# EasyEDA Pro project cubicat_pcb.eprj, board PCB
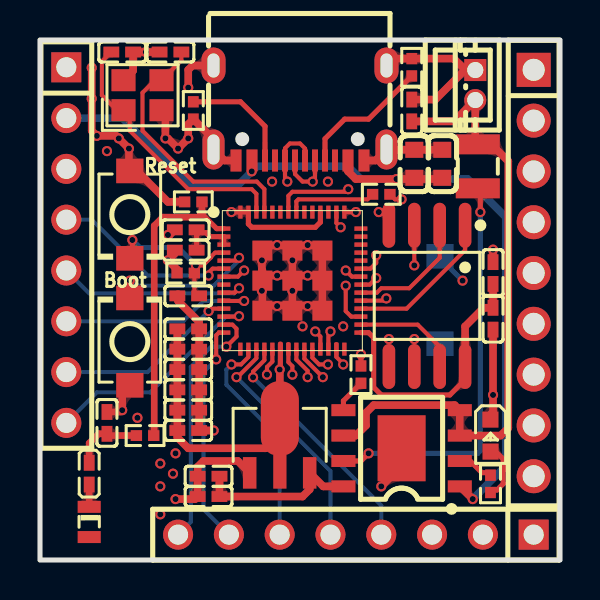
[diagram p7: board, top side]
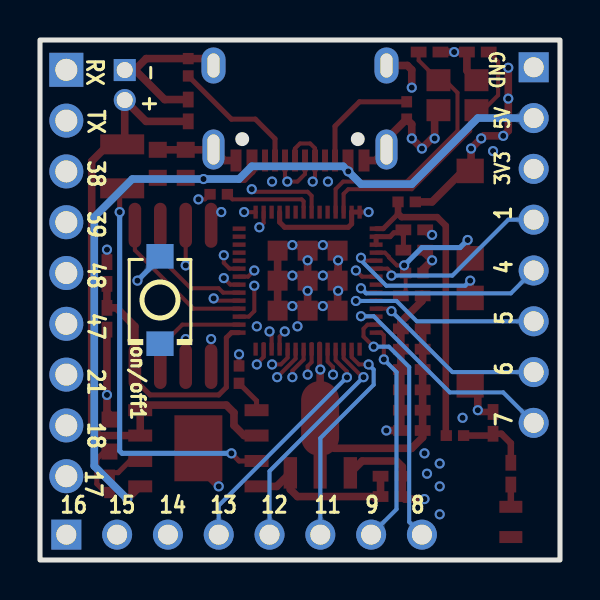
[diagram p8: board, bottom side, seen from below]

Outline 26 x 26 mm; copper layers: Top Layer, GND, PWR, Bottom Layer. Coordinates in mm from the lower left corner of the outline.
Outline path: rectangle 0,26 26,0
Stack: Top Layer 0.035mm 外层铜厚1oz / Dielectric1 0.2104mm 7628 RC49% 8.6mil / GND 0.0152mm 内层铜厚 / Dielectric2 1.065mm 1.1mm H/HOZ 含铜 / PWR 0.0152mm 内层铜厚 / Dielectric3 0.2104mm 7628 RC49% 8.6mil / Bottom Layer 0.035mm 外层铜厚1oz

## Design rules (mm)
net D-: USB-OTG
net D+: USB-OTG
template: 自定义配置
spacing copperThickness1oz (default): track to track 0.102, other pairs 0.152 to 0.3
spacing copperThickness2oz: track to track 0.203, other pairs 0.152 to 0.3
track width copperThickness1oz (default): min 0.127, default 0.254, max 2.54
track width copperThickness2oz: min 0.203, default 0.254, max 2.54
differential pair 90ohm (default): width min 0.203, default 0.203, max 0.229; gap min 0.152, default 0.203
via viaSize (default): diameter min 0.5, default 0.508, max 10; hole min 0.3, default 0.305, max 6.299

## Placement (name value [footprint] x y rotation side)
ANT1  KH-1608-H08  [ANT-SMD_L1.7-W0.9]  2.46 1.9 90 top
BAT1  A1501WV-2P  [CONN-TH_A1501WV-2P]  21.76 23.75 270 top
Boot  TS-1088-AR02016  [SW-SMD_L3.9-W3.0-P4.45]  4.49 10.92 90 top
C4  10uF  [C0402]  18.59 22.48 90 top
C6  10uF  [C0402]  8.43 3.17 180 top
C7  10uF  [C0603]  20.11 19.81 270 top
C8  10uF  [C0603]  18.72 19.81 270 top
C9  10uF  [C0402]  8.43 4.19 180 top
C13  10uF  [C0402]  7.41 7.49 180 top
C14  100nF  [C0402]  7.41 6.47 180 top
C15  1uF  [C0402]  7.41 13.21 0 top
C16  10uF  [C0402]  7.41 9.52 180 top
C17  1uF  [C0402]  7.41 11.56 180 top
C18  100nF  [C0402]  7.28 16.51 0 top
C20  15pF  [C0402]  4.11 25.4 0 top
C21  15pF  [C0402]  6.52 25.4 0 top
C22  1uF  [C0402]  7.41 8.51 180 top
C23  100nF  [C0402]  22.65 12.06 90 top
C24  1uF  [C0402]  22.65 14.35 270 top
C25  1.5pF  [C0402]  3.35 6.86 270 top
C30  10uF  [C0402]  7.41 10.54 180 top
ESP32S3R8  -  [esp32s3R8]  12.62 13.97 0 top
H1  PZ254V-11-09P  [HDR-TH_9P-P2.54-V-M]  24.68 14.35 270 top
L1  2.2uH  [IND-SMD_L2.5-W2.0_MHCHL2520]  21.89 19.68 90 top
L2  2nH  [L0402]  7.28 15.49 0 top
L3  5.6nH  [L0402]  2.46 4.32 90 top
LED1  19-213/Y2C-CQ2R2L/3T(CY)  [LED0603-RD-YELLOW]  22.53 6.22 270 top
on/off1  TS-1088-AR02016  [SW-SMD_L3.9-W3.0-P4.45]  20 13 270 bottom
Q1  AMS1117-3.3  [SOT-89_L4.5-W2.5-P1.50-LS4.2-BR]  11.98 5.71 270 top
R5  200Ω  [R0402]  22.53 3.81 90 top
R7  10kΩ  [R0402]  7.28 14.35 180 top
R9  5.1kΩ  [R0402]  7.67 22.48 90 top
R10  5.1kΩ  [R0402]  18.59 24.64 90 top
R11  10kΩ  [R0402]  16.05 9.27 90 top
R14  0Ω  [R0402]  5.25 6.22 0 top
R15  0Ω  [R0402]  7.67 17.91 0 top
R22  470Ω  [R0402]  17.06 18.29 0 top
Reset  TS-1088-AR02016  [SW-SMD_L3.9-W3.0-P4.45]  4.49 17.27 270 top
U6  IP5305T  [ESOP-8_L4.9-W3.9-P1.27-LS6.0-BL-EP]  18.08 5.59 90 top
U21  W25Q128JVSIQ  [SOIC-8_L5.3-W5.3-P1.27-LS8.0-BL]  19.35 13.21 180 top
U22  HB-PH3-25418PB2GOP  [HDR-TH_8P-P2.54-V-M]  15.79 1.27 180 top
U24  HB-PH3-25418PB2GOP  [HDR-TH_8P-P2.54-V-M]  1.32 15.75 270 top
USB1  TYPE-C 16PIN 2MD(073)  [USB-C-SMD_TYPE-C-6PIN-2MD-073]  13 22.35 180 top
X1  40MHz  [CRYSTAL-SMD_4P-L2.5-W2.0-BL]  5.13 23.24 0 top

## Footprints (pads in the part's own frame, mm; a bottom-side part is the same pattern mirrored in y, then rotated)
ANT-SMD_L1.7-W0.9
  rect 0.6x1.15 smd: 1(-0.756,0) 2(0.756,0)
C0402
  rect 0.79x0.54 smd: 1(-0.545,0) 2(0.545,0)
C0603
  rect 0.8x0.9 smd: 1(-0.7,0) 2(0.7,0)
CONN-TH_A1501WV-2P
  rect 1.1x1.1 hole 0.8: 1(-0.75,0)
  round 1.1 hole 0.8: 2(0.75,0)
CRYSTAL-SMD_4P-L2.5-W2.0-BL
  rect 1.2x1.1 smd: 1(-0.95,-0.75) 2(0.95,-0.75) 3(0.95,0.75) 4(-0.95,0.75)
ESOP-8_L4.9-W3.9-P1.27-LS6.0-BL-EP
  rect 0.6x1.2 smd: 1(-1.905,-2.909) 2(-0.635,-2.909) 3(0.635,-2.909) 4(1.905,-2.909) 5(1.905,2.909) 6(0.635,2.909) 7(-0.635,2.909) 8(-1.905,2.909)
  rect 3.3x2.4 smd: 9(0,0)
esp32s3R8
  rect 0.65x0.22 smd: 1(-3.425,2.6) 2(-3.425,2.2) 3(-3.425,1.8) 4(-3.425,1.4) 5(-3.425,1) 6(-3.425,0.6) 7(-3.425,0.2) 8(-3.425,-0.2) 9(-3.425,-0.6) 10(-3.425,-1) 11(-3.425,-1.4) 12(-3.425,-1.8) 13(-3.425,-2.2) 14(-3.425,-2.6) 29(3.425,-2.6) 30(3.425,-2.2) 31(3.425,-1.8) 32(3.425,-1.4) 33(3.425,-1) 34(3.425,-0.6) 35(3.425,-0.2) 36(3.425,0.2) 37(3.425,0.6) 38(3.425,1) 39(3.425,1.4) 40(3.425,1.8) 41(3.425,2.2) 42(3.425,2.6)
  rect 0.22x0.65 smd: 15(-2.6,-3.425) 16(-2.2,-3.425) 17(-1.8,-3.425) 18(-1.4,-3.425) 19(-1,-3.425) 20(-0.6,-3.425) 21(-0.2,-3.425) 22(0.2,-3.425) 23(0.6,-3.425) 24(1,-3.425) 25(1.4,-3.425) 26(1.8,-3.425) 27(2.2,-3.425) 28(2.6,-3.425) 43(2.6,3.425) 44(2.2,3.425) 45(1.8,3.425) 46(1.4,3.425) 47(1,3.425) 48(0.6,3.425) 49(0.2,3.425) 50(-0.2,3.425) 51(-0.6,3.425) 52(-1,3.425) 53(-1.4,3.425) 54(-1.8,3.425) 55(-2.2,3.425) 56(-2.6,3.425)
  rect 1x1 smd: 57(-1.5,1.5) 57(-1.5,0) 57(-1.5,-1.5) 57(0,1.5) 57(0,0) 57(0,-1.5) 57(1.5,1.5) 57(1.5,0) 57(1.5,-1.5)
HDR-TH_8P-P2.54-V-M
  rect 1.5x1.5 hole 1: 1(-8.89,0)
  round 1.5 hole 1: 2(-6.35,0) 3(-3.81,0) 4(-1.27,0) 5(1.27,0) 6(3.81,0) 7(6.35,0) 8(8.89,0)
HDR-TH_9P-P2.54-V-M
  rect 1.7x1.7 hole 1.1: 1(-10.16,0)
  round 1.7 hole 1.1: 2(-7.62,0) 3(-5.08,0) 4(-2.54,0) 5(0,0) 6(2.54,0) 7(5.08,0) 8(7.62,0) 9(10.16,0)
IND-SMD_L2.5-W2.0_MHCHL2520
  rect 1x2.2 smd: 1(-1.1,0) 2(1.1,0)
L0402
  rect 0.79x0.54 smd: 1(-0.545,0) 2(0.545,0)
LED0603-RD-YELLOW
  rect 0.8x0.8 smd: 1(-0.799,-0.004) 2(0.799,0.004)
R0402
  rect 0.566x0.54 smd: 1(-0.433,0) 2(0.433,0)
SOIC-8_L5.3-W5.3-P1.27-LS8.0-BL
  oval 0.63x2.25 smd: 1(-1.905,-3.53) 2(-0.635,-3.53) 3(0.635,-3.53) 4(1.905,-3.53) 5(1.905,3.53) 6(0.635,3.53) 7(-0.635,3.53) 8(-1.905,3.53)
SOT-89_L4.5-W2.5-P1.50-LS4.2-BR
  rect 1.575x0.672 smd: 1(1.356,-1.5) 3(1.356,1.5)
  custom 5.377x1.9 smd: 2(-1.356,0.009)
SW-SMD_L3.9-W3.0-P4.45
  rect 1.23x1.36 smd: 1(-2.185,0) 2(2.185,0)
USB-C-SMD_TYPE-C-6PIN-2MD-073
  rect 0.55x1.1 smd: 1(-3.2,2.375) 2(-2.4,2.375) 11(2.4,2.375) 12(3.2,2.375)
  rect 0.3x1.1 smd: 3(-1.75,2.375) 4(-1.25,2.375) 5(-0.75,2.375) 6(-0.25,2.375) 7(0.25,2.375) 8(0.75,2.375) 9(1.25,2.375) 10(1.75,2.375)
  oval 1.1x2 hole 0.6x1.5: 13(-4.325,1.825) 14(4.325,1.825)
  oval 1.2x1.8 hole 0.6x1.2: 13(-4.325,-2.375) 14(4.325,-2.375)

## Nets
As in the schematic, except:
GND: BAT1.1 Boot.1 C4.2 C6.2 C7.1 C8.1 C9.2 C13.1 C14.1 C15.1 C16.1 C17.1 C18.1 C20.2 C21.1 C22.1 C23.1 C24.1 C25.1 C30.1 ESP32S3R8.57 LED1.1 on/off1.2 Q1.1 R9.1 R10.2 R15.1 Reset.1 U6.9 U21.4 U24.1 USB1.1 USB1.12 USB1.13 USB1.14 X1.2 X1.4

Pads without a net: ANT1 1; ESP32S3R8 8 15 28 38 39 40 41 42 51 52; USB1 3 9

## Via types
v1: diameter 0.508, hole 0.305, Top Layer to Bottom Layer, 86 vias

## Routing (per net, layer and track width the routed paths; a pad name or vN(x,y) marks a point on that pad's centre or on a via; arc(x,y) is an arc through that point)
GND: length 77.1
  Top Layer w0.33: C25.1 4.02,7.4 v1(4.11,7.49)
  Top Layer w0.381: C21.1 v1(5.29,25.4) C20.2 4.66,24.47 X1.4 ; C24.1 v1(22.65,15.52) ; 12.62,15.72 14.12,15.72 14.12,14.22 ; 12.62,15.72 v1(12.62,14.98) 12.62,14.22 ; 12.62,15.72 11.12,15.72 11.12,15.01 v1(11.09,14.98) 11.09,14.5 11.12,14.48 11.09,14.45 11.09,14.22 ; C4.2 19.77,23.02 21.24,24.5 21.27,24.5 ; 12.62,14.22 v1(11.86,14.22) 11.09,14.22 ; 12.62,14.22 v1(12.62,13.46) 12.62,12.72 ; 12.62,14.22 v1(13.38,14.22) 14.12,14.22 ; 6.9,13.3 6.9,12.95 7.96,11.9 C17.1 C30.1 C16.1 C22.1 C13.1 C14.1 v1(8.68,6.47) ; 12.62,12.72 11.12,12.72 11.12,13.44 v1(11.09,13.46) 11.09,14.22 ; 12.62,12.72 14.12,12.72 14.12,14.22 ; USB1.1 16.78,19.97 USB1.13 17.34,20.51 C8.1 C7.1 ; v1(17.06,3.68) 18.08,4.7 U6.9 ; C18.1 6.49,16.25 v1(6.4,16.25) ; C23.1 v1(22.65,8.25) 22.65,7.41 22.52,7.27 ; U21.4 17.44,17.14 17.19,17.4 v1(16.94,17.4) ; Boot.1 4.11,8.35 v1(4.11,7.49) ; v1(6.78,3.05) 7.76,3.05 C6.2 C9.2 7.88,4.66 8.17,4.95 9.89,4.95 Q1.1 ; 21.27,24.5 20.69,25.07 R10.2 17.62,25.07 17.32,24.77 USB1.13 ; 21.27,24.5 BAT1.1 ; USB1.12 9.22,19.97 USB1.14 8.68,21.03 R9.1 7.41,21.79 v1(7.41,21.08) v1(6.9,20.57) 6.4,21.08 v1(6.27,21.08) 6.27,22.3 X1.2 ; USB1.14 7.63,24.72 7.41,24.51 v1(7.41,23.62) ; v1(2.59,24.61) v1(2.59,23.07) 2.59,21.46 v1(2.84,21.21) 3.81,21.21 v1(3.94,21.08) v1(4.45,20.57) 4.45,19.85 6.4,17.91 R15.1
  vias: v1(3.35,20.44) v1(4.87,7.11) v1(6.01,4.82) v1(6.01,3.68) v1(6.01,2.28) v1(6.65,4.32) v1(6.78,5.33) v1(11.6,18.92) v1(11.86,15.75) v1(11.86,12.7) v1(13.13,11.68) v1(13.38,15.75) v1(13.38,12.7) v1(14.4,18.92) v1(15.16,11.68)
VBUS_5V: length 46.4
  Top Layer w0.381: v1(10.59,19.43) 10.6,19.44 USB1.11 ; U6.1 21,3.68 v1(21.64,3.05) ; USB1.2 15.4,19.44 15.79,19.05 v1(17.83,19.05) 20.05,19.05 C7.2
  Bottom Layer w0.381: U24.2 4.11,22.1 7.41,18.79 9.95,18.79 v1(10.59,19.43) 10.84,19.68 15.41,19.68 16.05,19.05 v1(17.83,19.05) 21.38,19.05 23.29,17.14 23.29,4.7 v1(21.64,3.05)
VCC_3V3: length 33.2
  Top Layer w0.254: 12.02,10.8 12.02,9.56 v1(11.98,9.52) ; ESP32S3R8.46 14.02,16.89 13.76,16.64 10.59,16.64 10.42,16.8 ESP32S3R8.55 10.41,17.4 v1(9.57,17.4)
  Top Layer w0.381: 6.74,15.36 6.74,15.33 v1(6.4,14.98) 6.85,14.53 R7.2 ; C17.2 C30.2 C16.2 C22.2 C13.2 C14.2 6.87,6.13 7.41,5.59 11.27,5.59 11.99,6.31 11.99,9.51 v1(11.98,9.52)
  PWR w0.203: 11.86,14.98 11.22,15.62 ; 11.86,14.98 12.49,15.62 12.75,15.62 13.89,14.48 13.89,13.84 13.76,13.71 ; 11.86,14.98 11.09,14.22 11.86,13.46 ; 11.86,14.98 13.38,13.46 ; 11.86,13.46 11.22,12.83 ; 11.86,13.46 12.49,12.83
VCC_5V: length 8.5
  Top Layer w0.381: C9.1 C6.1 13.13,3.17 13.48,3.53 Q1.3 14.16,3.68 U6.8
VDD_SPI: length 13.9
  Top Layer w0.254: ESP32S3R8.29 16.43,11.37 16.68,11.11 16.68,8.63 17.06,8.25 20.49,8.25 21.25,9.02 U21.8
  Top Layer w0.381: C24.2 C23.2 22.18,12.61 21.25,11.68 U21.8
BAT: length 31.8
  Top Layer w0.381: U6.6 15.79,6.22 16.3,6.73 16.3,7.36 16.68,7.75 20.73,7.75 U6.4 U6.3 23.03,6.22 23.41,6.6 23.41,19.94 22.57,20.78 22.02,20.78 21.76,21.04 BAT1.2 20.7,21.93 C4.1
BOOT: length 7.9
  Top Layer w0.203: ESP32S3R8.5 9.81,14.97 v1(9.95,15.11)
  Top Layer w0.381: v1(4.49,13.97) Boot.2
  Bottom Layer w0.203: v1(9.95,15.11) 9.95,14.98 8.68,13.71 4.75,13.71 v1(4.49,13.97)
D+: length 15.1
  Top Layer w0.203: v1(14.52,11.43) 14.42,11.32 ESP32S3R8.26 ; USB1.6 13.25,19.98 13.25,20.57 13,20.83 12.49,20.83 12.25,20.58 USB1.8 12.25,19.04 v1(12.37,18.92)
  PWR w0.203: v1(14.52,11.43) 14.89,11.06 15.43,11.06 15.67,11.3 15.67,11.94 14.24,13.37 14.24,15.71 12.37,17.58 12.37,17.91 12.75,18.29 12.75,18.54 v1(12.37,18.92)
D-: length 15.7
  Top Layer w0.203: ESP32S3R8.25 14.02,11.17 v1(13.76,11.43) ; USB1.5 13.75,19.04 v1(13.63,18.92) 13.13,18.92 12.75,19.3 USB1.7
  PWR w0.203: v1(13.63,18.92) 13.2,18.49 13.2,17.32 14.64,15.88 14.64,13.48 16.05,12.07 16.05,11.17 15.54,10.67 14.52,10.67 v1(13.76,11.43)
GPIO1: length 9.3
  Top Layer w0.203: ESP32S3R8.6 8.63,14.57 8.43,14.36 v1(8.43,14.22)
  Bottom Layer w0.203: U24.4 2.59,17.02 5.38,14.22 v1(8.43,14.22)
GPIO2: length 1.1
  Top Layer w0.203: v1(10.21,14.48) 9.9,14.17 ESP32S3R8.7
GPIO4: length 10.1
  Top Layer w0.203: v1(9.95,13.59) 9.73,13.37 ESP32S3R8.9
  Bottom Layer w0.203: U24.5 2.46,13.33 9.7,13.33 v1(9.95,13.59)
GPIO5: length 10.3
  Top Layer w0.203: ESP32S3R8.10 9.21,12.95 v1(10.21,12.95)
  Bottom Layer w0.203: v1(10.21,12.95) 8.17,12.95 7.16,11.94 U24.6
GPIO6: length 9.2
  Top Layer w0.203: ESP32S3R8.11 8.55,12.57 v1(8.43,12.44)
  Bottom Layer w0.203: v1(8.43,12.44) 5.38,9.4 U24.7
GPIO7: length 11.6
  Top Layer w0.203: v1(9.95,12.19) 9.93,12.17 ESP32S3R8.12
  Bottom Layer w0.203: v1(9.95,12.19) 9.32,12.19 5.51,8.38 2.84,8.38 U24.8
GPIO8: length 12.7
  Top Layer w0.203: ESP32S3R8.13 9.62,11.77 9.82,11.56 9.82,11.17 v1(9.32,10.67)
  Bottom Layer w0.203: v1(9.32,10.67) 8.56,10.67 7.54,9.65 7.54,1.9 U22.8
GPIO9: length 11.2
  Top Layer w0.203: v1(8.81,10.03) 8.81,11.24 8.94,11.37 ESP32S3R8.14
  Bottom Layer w0.203: v1(8.81,10.03) 8.17,9.4 8.17,2.54 U22.7
GPIO11: length 11.1
  Top Layer w0.203: ESP32S3R8.16 10.42,10.15 10.05,9.78 v1(9.57,9.78)
  Bottom Layer w0.203: v1(9.57,9.78) 9.32,9.52 9.32,8.76 11.98,6.09 U22.6
GPIO12: length 11.7
  Top Layer w0.203: ESP32S3R8.17 10.82,10.09 9.87,9.14 v1(9.82,9.14)
  Bottom Layer w0.203: U22.5 14.52,4.44 v1(9.82,9.14)
GPIO13: length 12.2
  Top Layer w0.203: ESP32S3R8.18 11.22,9.99 10.65,9.42 v1(10.65,9.13)
  Bottom Layer w0.203: v1(10.65,9.13) 17.06,2.72 U22.4
GPIO14: length 13.5
  Top Layer w0.203: v1(11.35,9.27) 11.35,9.65 11.62,9.92 ESP32S3R8.19
  PWR w0.203: U22.3 19.6,2.16 17.06,4.7 15.92,4.7 v1(11.35,9.27)
GPIO15: length 14.6
  Top Layer w0.203: v1(12.62,9.27) 12.62,9.69 12.42,9.89 12.42,10.8
  PWR w0.203: v1(12.62,9.27) 12.62,9.02 15.67,5.97 17.44,5.97 U22.2
GPIO16: length 16.2
  Top Layer w0.203: v1(13.38,9.14) 13.38,9.46 12.82,10.02 ESP32S3R8.22
  PWR w0.203: U22.1 19.48,6.47 16.05,6.47 v1(13.38,9.14)
GPIO17: length 14.4
  Top Layer w0.203: v1(14.14,9.14) 13.22,10.07 ESP32S3R8.23
  PWR w0.203: H1.9 21.76,7.11 16.18,7.11 v1(14.14,9.14)
GPIO18: length 12.9
  Top Layer w0.203: ESP32S3R8.24 13.62,10.12 13.96,9.78 v1(14.4,9.78)
  PWR w0.203: H1.8 23.67,7.75 16.43,7.75 v1(14.4,9.78)
GPIO21: length 10.9
  Top Layer w0.203: v1(15.16,9.78) 15.16,9.81 14.82,10.15 14.82,10.8
  PWR w0.203: v1(15.16,9.78) 15.67,9.27 H1.7
GPIO38: length 10.8
  Top Layer w0.203: ESP32S3R8.43 15.79,17.39 v1(15.79,17.4)
  PWR w0.203: H1.3 23.03,19.43 21,17.4 17.83,17.4 17.19,18.03 16.56,18.03 15.92,17.4 v1(15.79,17.4)
GPIO39: length 10.6
  Top Layer w0.203: ESP32S3R8.44 14.82,16.85 v1(15.03,16.64)
  PWR w0.203: 24.68,16.89 24.43,16.64 v1(15.03,16.64)
GPIO47: length 10.6
  Top Layer w0.203: ESP32S3R8.37 16.52,14.57 16.81,14.86 v1(16.81,15.24)
  PWR w0.203: v1(16.81,15.24) 21.25,15.24 H1.6
GPIO48: length 11.4
  Top Layer w0.203: v1(15.29,14.48) 15.59,14.17 ESP32S3R8.36
  PWR w0.203: v1(15.29,14.48) 16.56,15.75 21.51,15.75 22.91,14.35 H1.5
RESET: length 8
  Top Layer w0.203: C15.2 7.72,13.45 R7.1 7.79,14.42 v1(7.79,14.73) 8.15,14.73 8.56,15.13 8.56,15.17 8.76,15.37 ESP32S3R8.4
  Top Layer w0.254: Reset.2 4.62,15.21 v1(4.62,16)
  Bottom Layer w0.254: v1(7.79,14.73) 6.9,15.62 5,15.62 v1(4.62,16)
RXD: length 15.7
  Top Layer w0.203: 12.42,17.65 12.42,18.21 12.62,18.41 15.29,18.41 v1(15.41,18.54)
  PWR w0.203: H1.1 24.68,24.13 19.1,18.54 v1(15.41,18.54)
SPICLK: length 3.9
  Top Layer w0.203: ESP32S3R8.33 17.21,12.97 v1(17.32,13.08)
  PWR w0.203: v1(17.32,13.08) 17.32,12.44 v1(18.72,11.05)
SPICS0: length 7.7
  Top Layer w0.203: ESP32S3R8.32 18.33,12.57 21.25,15.49 U21.1
SPID: length 4.2
  Top Layer w0.203: ESP32S3R8.35 16.48,13.77 v1(16.81,14.09)
  PWR w0.203: v1(17.44,11.05) 16.81,11.68 v1(16.81,14.09)
SPIHD: length 5.4
  Top Layer w0.203: U21.7 19.99,10.67 18.88,11.77 ESP32S3R8.30
SPIQ: length 6.3
  Top Layer w0.203: ESP32S3R8.34 16.84,13.37 17.06,13.59 18.46,13.59 19.99,15.11 U21.2
SPIWP: length 8
  Top Layer w0.203: ESP32S3R8.31 15.56,12.17 15.29,12.44 v1(15.29,13.71) ; v1(18.72,14.73) U21.3
  PWR w0.203: v1(18.72,14.73) 16.3,14.73 v1(15.29,13.71)
TXD: length 8.9
  Top Layer w0.203: v1(18.08,18.03) 17.75,18.03 R22.2
  PWR w0.203: 24.68,21.97 20.75,18.03 v1(18.08,18.03)
$1N4062: length 20.2
  Top Layer w0.254: v1(16.43,5.33) 16.05,4.95 U6.7 ; v1(22.02,17.4) 22.02,18.46 L1.1
  Bottom Layer w0.254: v1(16.43,5.33) 21.89,5.33 22.02,5.46 v1(22.02,17.4)
$1N4068: length 2.9
  Top Layer w0.254: 22.53,5.68 23.16,5.04 23.16,3.81 22.85,3.5 22.53,3.5
$1N4069: length 1.8
  Top Layer w0.254: U6.2 21.51,4.95 22.09,4.37 22.53,4.37
$1N4090: length 6.7
  Top Layer w0.254: USB1.4 14.25,21.06 15.23,22.04 16.43,22.04 18.59,24.2
$1N4091: length 5.8
  Top Layer w0.254: USB1.10 11.25,21.69 10.03,22.91 R9.2
$1N4092: length 9.8
  Top Layer w0.254: R11.2 v1(16.05,10.28)
  PWR w0.254: v1(16.05,10.28) 18.97,10.28 21.13,12.44 v1(21.13,13.97)
  Bottom Layer w0.254: on/off1.1 20,15.1 v1(21.13,13.97)
$1N4094: length 1.7
  Top Layer w0.254: U6.5 15.17,7.96 R11.1
$1N4114: length 13.4
  Top Layer w0.203: C21.2 7.07,24.98 X1.3 5.75,23.99 5.13,23.37 5.13,21.46 7.67,18.92 10.84,18.92 11.22,18.54 ESP32S3R8.53
$1N4115: length 13.5
  Top Layer w0.203: 3.56,25.4 3.09,24.93 3.09,23.24 3.84,22.49 X1.1 4.49,22.17 4.49,21.46 7.41,18.54 10.59,18.54 10.82,18.31 ESP32S3R8.54
$1N4126: length 2.7
  Top Layer w0.254: ESP32S3R8.3 ESP32S3R8.2 8.5,16.17 8.3,16.36 7.94,16.36 7.83,16.25 L2.2
$1N4130: length 1.1
  Top Layer w0.33: ANT1.2 L3.1
$1N4132: length 3.3
  Top Layer w0.33: 4.57,6.22 3.44,6.22 C25.2 2.93,6.31 2.46,5.84 L3.2
$1N4134: length 15.1
  Top Layer w0.254: ESP32S3R8.1 8.84,16.57 8.1,17.3 8.1,17.32
  Top Layer w0.33: R15.2 8.1,17.32 7.92,17.14 6.14,17.14 5.71,16.71 5.71,6.25 R14.2
$1N4203: length 4.2
  Top Layer w0.203: 12.82,17.65 12.82,17.93 12.92,18.03 16.38,18.03 R22.1

## Copper pours and planes (outline as drawn; the poured copper is in the pictures)
GND on Bottom Layer: -2.75,28.45 27.86,28.45 27.86,-2.03 -2.75,-2.03
GND on GND: -3.13,28.95 29,28.95 29,-4.19 -3.13,-4.19
VCC_3V3 on PWR: -2.49,27.94 27.99,27.94 27.99,-1.65 -2.49,-1.65

Small or netless copper shapes (teardrops, artwork), in the pictures only: 233 on Top Layer, 33 on Bottom Layer, 39 on PWR

## Text on the board
Bottom Silkscreen Layer: GND | 5V | 3V3 | 8 | 9 | 11 | 12 | 13 | 14 | 15 | 16 | - | + | TX | 38 | 39 | 48 | 47 | 21 | 18 | RX | 17 | 4 | 5 | 6 | 7 | 1
